# EasyEDA Pro project STM32G303的双FOC电机驱动.eprj, board motor_drivev1.3 (continued)
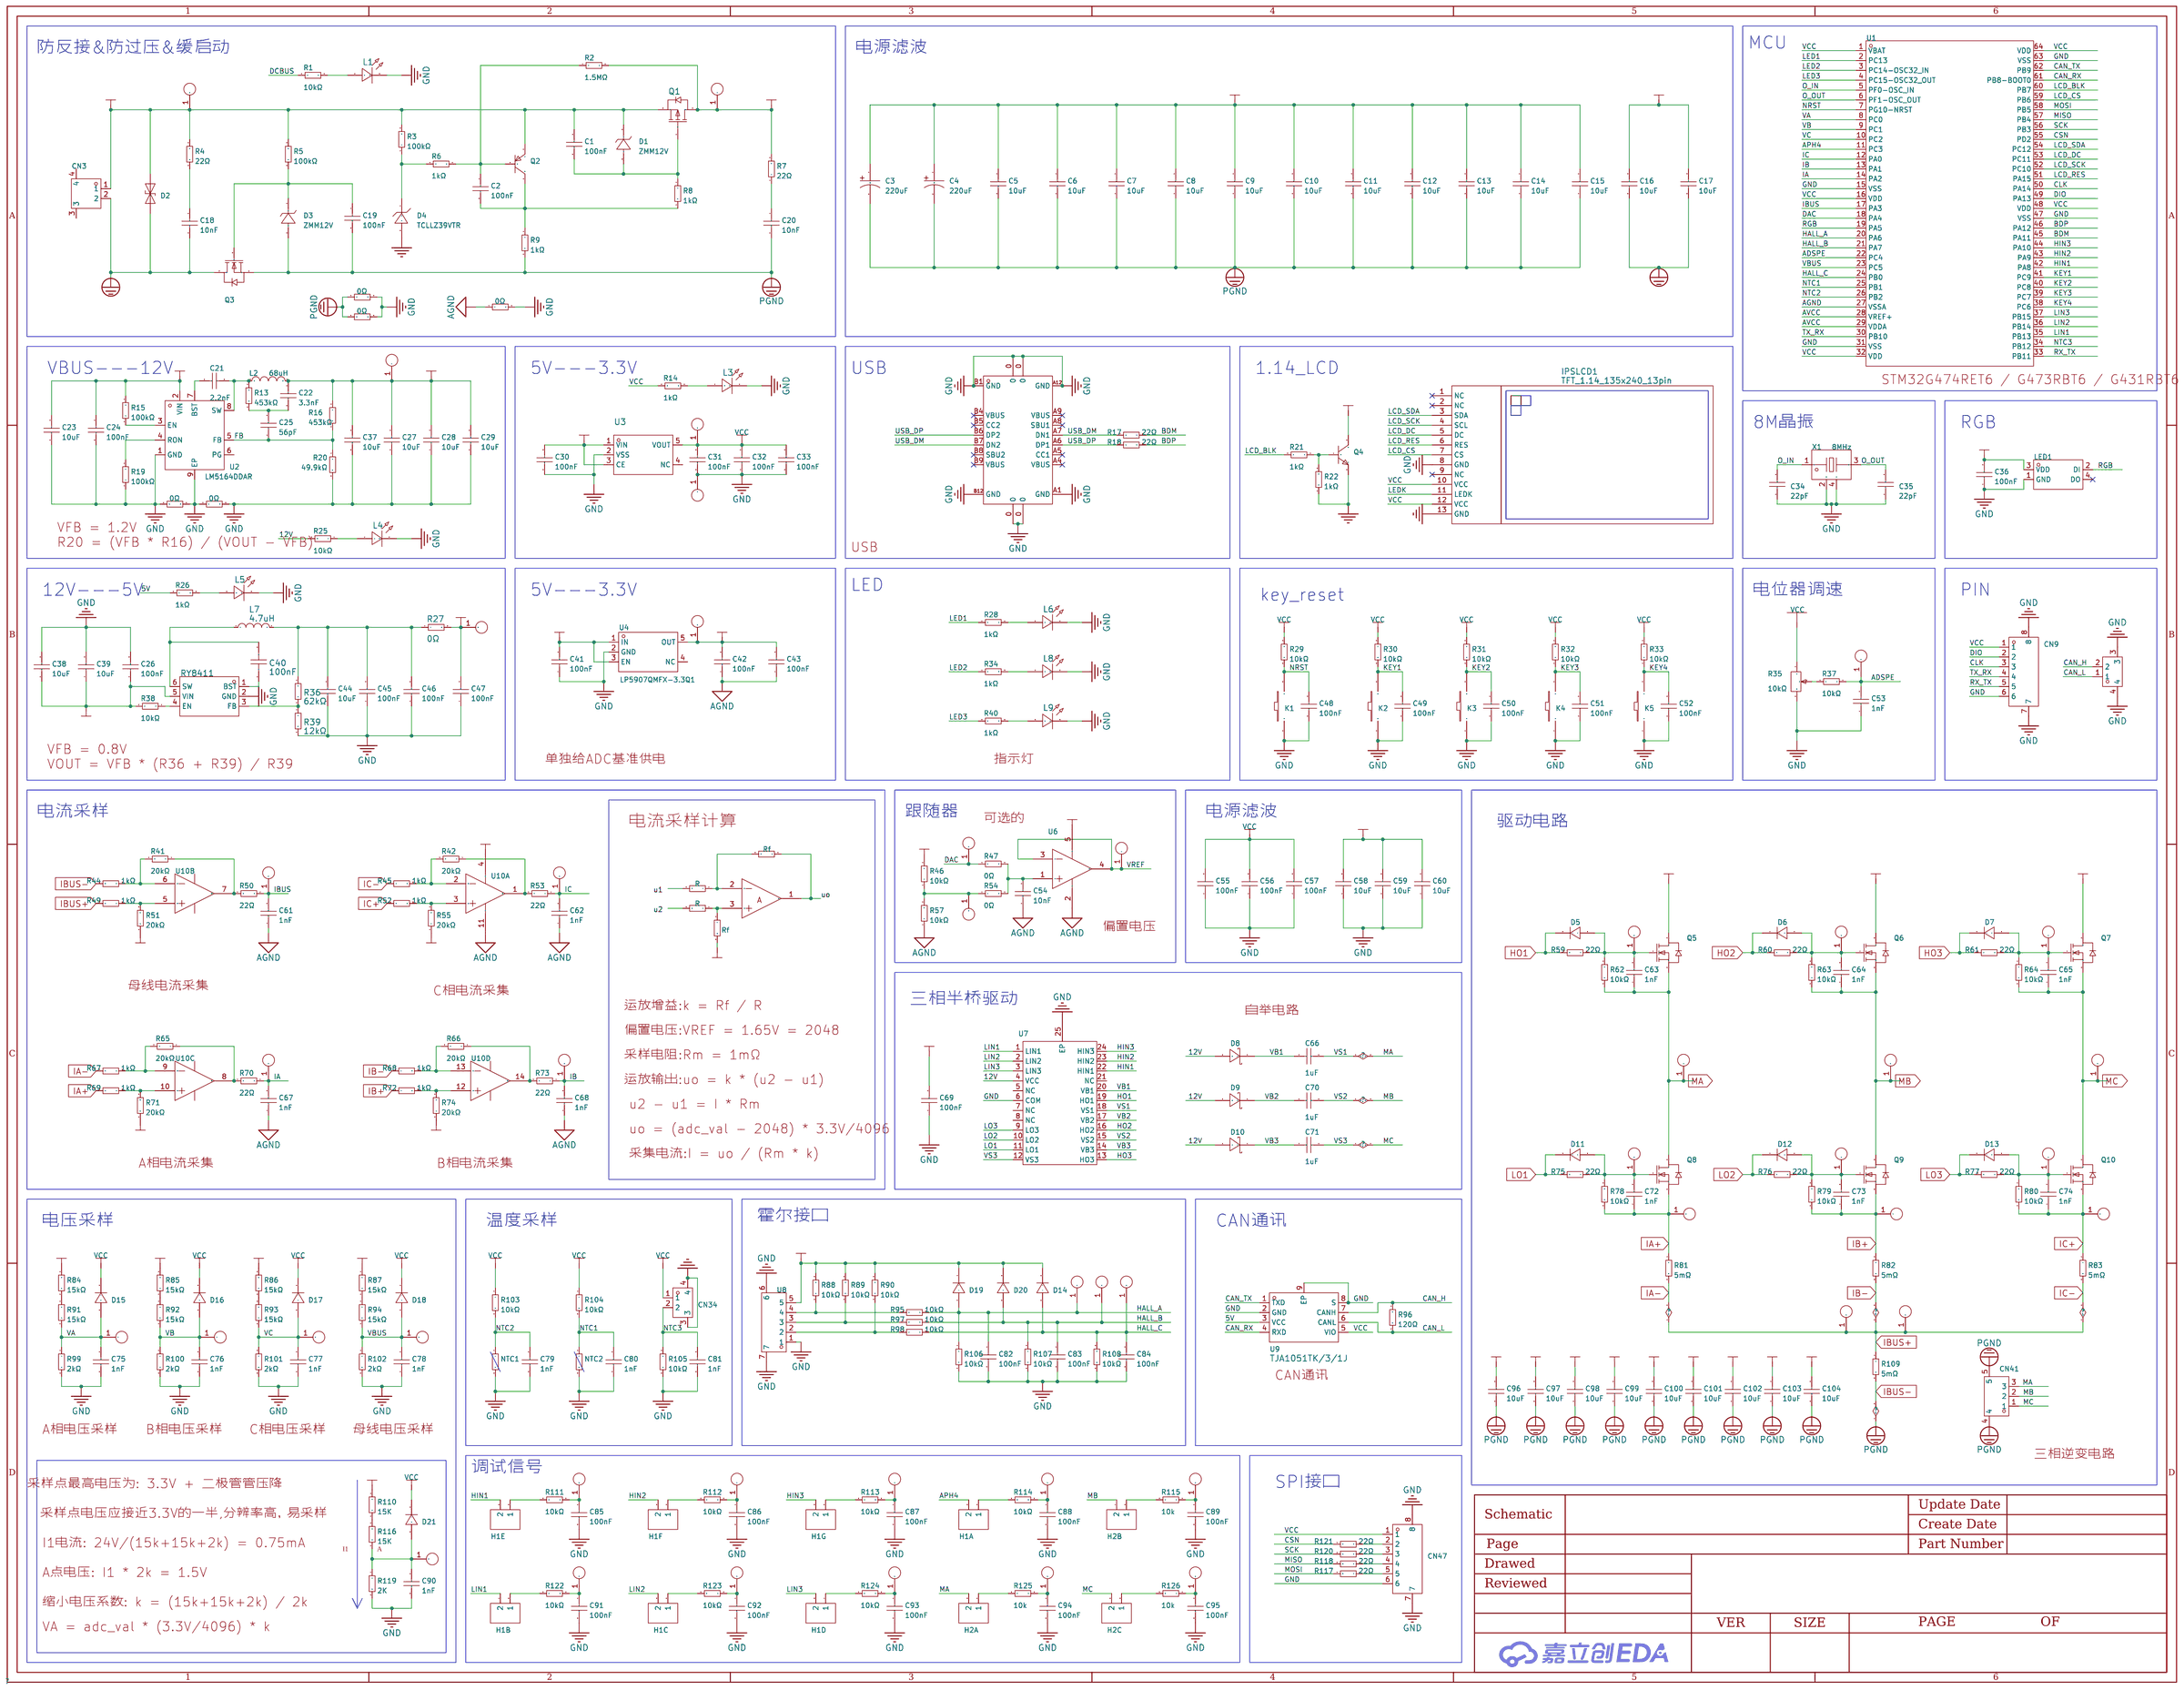
[diagram p0: schematic sheet]
## Routing (per net, layer and track width the routed paths; a pad name or vN(x,y) marks a point on that pad's centre or on a via; arc(x,y) is an arc through that point) (continued)
MB2: length 29.8
  Top Layer w0.254: v2(74.66,12.34) 76,13.67 C113.1 75.94,15.44 R132.2 ; U22.15 83.87,28.28 84.51,27.64 84.51,23.22 H2.3
  Inner2 w0.254: v1(88.13,30.75) 85.46,30.75 81.14,26.44 81.14,23.13 81.52,22.75 84.04,22.75 H2.3
  Bottom Layer w0.254: v1(88.13,30.75) 87.81,30.75 C106.1
  Bottom Layer w0.762: Q36.6 74.96,12.63 v2(74.66,12.34)
  vias: v2(73.52,13.12) v2(73.52,12.18) v2(73.52,10.89) v2(74.3,13.28) v2(74.66,10.89) v2(74.73,11.7) v2(75.9,12.24) v2(75.9,10.83) v2(76.77,11.5) v2(76.77,10.71) v2(77.04,12.18)
MC: length 43.3
  Top Layer w0.254: C71.1 41.14,35.23 43.2,33.17 v2(43.61,33.17) ; U7.12 40.54,24.55 v2(41.01,24.09)
  Top Layer w0.762: H1.4 26.08,23.14 27.74,21.48 v2(28.56,21.48)
  Bottom Layer w0.254: 28.92,21.21 31.8,24.09 v2(41.01,24.09) 41.94,25.02 42.05,24.91 42.72,24.91 44.44,26.63 44.44,30.82 43.61,31.64 v2(43.61,33.17)
  Bottom Layer w0.762: v2(28.56,21.48) 28.92,21.12 Q32.8
  vias: v2(24.24,21.16) v2(24.5,20.47) v2(25.48,21.17) v2(25.48,20.69) v2(25.83,19.96) v2(26.46,21.17) v2(26.64,20.47) v2(26.64,19.61)
MC2: length 43.7
  Top Layer w0.254: v2(82.03,24.78) 82.07,24.83 U22.12 ; R133.2 75.69,4.27 C114.1 77.65,7.32 v2(77.08,7.89)
  Top Layer w0.762: v2(84.42,18.94) 84.42,8.95 83.14,7.67 82.38,7.67 82.03,8.02 80.23,8.02 79.97,7.77 79.01,7.77 78.95,7.7 77.33,7.7 77.11,7.92
  Inner1 w0.254: v2(86.09,27.77) 84.49,26.17 82.67,26.17 82.49,25.99 82.49,24.99 82.28,24.78 v2(82.03,24.78)
  Bottom Layer w0.254: C107.1 87.24,27.77 v2(86.09,27.77) ; v2(82.03,24.78) 82.47,24.34 82.47,20.09 83.62,18.94 v2(84.42,18.94)
  Bottom Layer w0.762: v2(77.08,7.89) 74.11,7.89 Q38.8
  vias: v2(73.22,8.17) v2(73.22,7.43) v2(73.22,6.52) v2(74.35,8.15) v2(74.45,7.43) v2(74.6,6.5) v2(75.52,8.15) v2(75.52,7.43) v2(75.52,6.7)
MT2CK: length 90.9
  Top Layer w0.254: U32.10 66.62,51.18 67.23,50.56 67.23,49.99 67.42,49.8 v1(75.74,49.8)
  Inner1 w0.254: v1(75.74,49.8) 78.41,52.47 78.41,54.31 81.52,57.42 86.09,57.42 88.57,54.95 88.57,51.52 90.09,49.99 91.74,49.99 93.47,48.27 97.22,48.27 97.4,48.09 97.4,47.83 97.21,47.64 97.21,38.62 97.53,38.3 97.53,31.33 95.75,29.55 95.75,6.12 94.52,4.89 CN76.5
MT2CS: length 46.1
  Top Layer w0.254: v2(77.9,42.37) 77.9,43.61 U32.51
  Inner1 w0.254: CN76.4 90.54,7.89 88.82,9.61 88.82,12.53 92.19,15.89 92.19,25.67 91.04,26.83 88.87,26.83 88.87,26.9 87.81,27.96 87.81,29.1 85.91,31 84.89,31 81.14,34.75 81.14,38.63 77.9,41.87 v2(77.9,42.37)
MT2DO: length 43.3
  Top Layer w0.254: v2(83.62,42.18) 82.03,42.18 79.54,44.68 U32.53
  Inner1 w0.254: CN76.2 90.94,14.07 92.6,15.73 92.6,25.84 91.05,27.39 89.65,27.39 89.65,36.15 v2(83.62,42.18)
MTCK: length 109
  Top Layer w0.254: U32.89 69.78,56.02 70.28,55.52 v2(70.28,55.14)
  Inner1 w0.254: CN75.5 5.96,11.23 5.96,20.4 9.64,24.09 9.64,46.44 17.39,54.18 23.99,54.18 31.04,61.23 53.84,61.23 54.03,61.42 54.28,61.42 57.39,58.31 67.11,58.31 v2(70.28,55.14)
MTCS: length 120
  Top Layer w0.254: v2(72.57,55.64) 72.78,55.86 U32.83
  Inner1 w0.254: CN75.4 9.3,8.04 7.86,9.48 5.07,9.48 4.5,10.05 4.5,14.01 5.55,15.07 5.55,20.57 9.23,24.25 9.23,46.61 17.64,55.01 22.91,55.01 31.93,64.03 33.63,64.03 34.01,63.65 35.48,63.65 37.3,61.83 54.45,61.83 57.46,58.82 69.39,58.82 v2(72.57,55.64)
MTDO: length 92.4
  Top Layer w0.254: U32.31 66.78,40.52 64.98,38.72 64.73,38.72 64.69,38.75 v1(62.41,38.75)
  Inner2 w0.254: CN75.2 10.89,4.89 11.99,5.99 11.99,10.31 7.35,14.94 7.35,26.5 12.94,32.09 48.88,32.09 55.55,38.75 v1(62.41,38.75)
NRST: length 9.2
  Top Layer w0.254: U32.14 60.38,49.18 59.04,47.83 58.15,47.83 57.14,46.82 57.14,45.1 56.7,44.66 U52.2
O_IN: length 10.7
  Top Layer w0.254: U32.12 58.02,50.18 57.58,49.74 55.49,49.74 54.76,50.46 X1.1 54.81,50.82 C34.2
O_OUT: length 8.9
  Top Layer w0.254: C35.2 56.46,46.73 X1.3 58.7,48.58 59.8,49.68 U32.13
OUT3: length 35.2
  Top Layer w0.254: v2(60.06,55.84) 60.22,55.68 U32.1
  Inner1 w0.254: v2(60.06,55.84) 59.42,55.84 42.47,38.88 42.47,37.48 41.39,36.4 v2(38.28,36.4)
  Bottom Layer w0.254: R203.2 37.06,36.4 v2(38.28,36.4)
RELAY1: length 30.5
  Top Layer w0.254: v2(59.61,55.01) 59.78,55.18 U32.2 ; v2(46.47,35.96) R176.2
  Inner2 w0.254: v2(59.61,55.01) 56.69,55.01 52.44,50.76 52.44,41.93 v2(46.47,35.96)
RELAY2: length 30.1
  Top Layer w0.254: v2(46.02,48.91) 46.02,48.73 R177.2 ; U32.3 v2(64.69,54.68)
  Inner1 w0.254: v2(64.69,54.68) 64.33,54.68 62.34,56.66 46.85,56.66 46.28,56.09 46.28,49.17 v2(46.02,48.91)
RS485-B: length 49.1
  Top Layer w0.254: U42.4 95.55,34.88 96.44,35.77 96.44,37.42 95.75,38.12 91.72,38.12 89.93,36.33 R195.2 ; R195.2 89.85,36.28 88.76,36.28 88.13,35.64 U41.7 85.56,35.64 85.51,35.59 84.65,35.59 84.47,35.77 84.32,35.77 84.32,37.42 82.78,38.95 82.78,39.47 ; R195.2 89.9,37.84 88.08,39.67 D34.2
  Inner1 w0.508: U42.4 96.23,34.88 96.99,35.64 96.99,38.08 96.63,38.44 95.22,38.44 91.17,42.49 91.17,47.26 88.24,50.2 CN77.2
RS485_A: length 48.9
  Top Layer w0.254: v2(92,31.2) 90.93,32.26 D33.2 89.9,32.52 R195.1 88.96,34.83 v1(88.63,34.5) 88.51,34.37 U41.6 ; v2(84.82,38.44) 84.82,39.22 R196.1
  Inner1 w0.254: v1(88.63,34.5) 88.63,34.63 v2(84.82,38.44)
  Inner1 w0.508: U42.6 94.46,36.88 89.88,41.47 89.88,43.42 89.08,44.22 88.57,44.22 88.46,44.11 87.96,44.11 87.15,44.91 86.24,44.91 84.46,46.69 84.46,50.59 86.08,52.2 CN77.3
  Bottom Layer w0.254: v2(92,31.2) 96.06,31.2 96.63,31.77 96.63,35.33 95.08,36.88 U42.6
RX1: length 26.6
  Top Layer w0.254: U32.34 68.28,47.61 v2(68.19,47.71)
  Bottom Layer w0.254: v2(68.19,47.71) 48.63,47.71 47.95,48.39 U50.2
RX3: length 14.8
  Top Layer w0.203: R194.1 78.97,34.88 78.83,35.02 76.15,35.02 74.28,36.89
  Top Layer w0.254: R194.1 81.13,33.36 U41.4 ; 74.28,36.89 U32.46
RX_TX: length 16.1
  Top Layer w0.254: U32.77 75.78,58.28 76.45,58.95 81.58,58.95 v2(84,56.53)
  Inner1 w0.254: CN81.5 82.55,52.74 84,54.18 v2(84,56.53)
SCL: length 25
  Top Layer w0.254: U31.6 80.19,68.21 R173.1 ; v2(66.85,55.51) 66.78,55.58 U32.95
  Top Layer w0.508: U31.6 80.19,65.42 v2(79.39,64.63)
  Bottom Layer w0.254: v2(66.85,55.51) 66.85,58.92 67.12,59.19 73.96,59.19 v2(79.39,64.63)
SDA: length 27.4
  Top Layer w0.254: R174.1 82.16,67.91 81.46,67.21 U31.5 81.39,66.48 v2(81.39,63.9) ; v2(67.68,55.45) 67.78,55.45 U32.93
  Bottom Layer w0.254: v2(67.68,55.45) 67.68,56.47 67.81,56.47 67.81,58.38 76.12,58.38 76.12,60.79 79.24,63.9 v2(81.39,63.9)
TX1: length 23.1
  Top Layer w0.254: U32.33 67.78,45.95 v2(67.61,46.12) ; U50.1 51.36,47.42 v2(51.36,46.95)
  Bottom Layer w0.254: v2(51.36,46.95) 66.79,46.95 v2(67.61,46.12)
TX3: length 12.5
  Top Layer w0.203: U41.1 78.41,36.91 78.09,37.23 77.58,37.23 76.38,36.02 76.12,36.02 74.78,37.37 U32.47
TX_RX: length 24.1
  Top Layer w0.254: U32.25 62.73,43.65 v2(62.09,43.01)
  Inner2 w0.254: CN81.4 81.39,50.8 80.68,51.52 73.96,51.52 66.15,43.71 62.79,43.71 v2(62.09,43.01)
VB1: length 4.2
  Top Layer w0.254: U7.20 40.04,30.26 39.5,30.8 C66.2 D8.1
VB2: length 11
  Top Layer w0.254: U7.17 41.79,28.2 42.72,29.14 42.72,31.7 42.21,32.21 39.8,32.21 39.63,32.39 C70.2 39.5,33.1 D9.1
VB3: length 14.9
  Top Layer w0.254: v1(39.36,34.5) 39.63,34.77 C71.2 39.5,35.13 D10.1 ; U7.14 41.7,26.7 v1(42.34,26.05)
  Bottom Layer w0.254: v1(42.34,26.05) 42.53,26.24 42.53,32.91 40.95,34.5 v1(39.36,34.5)
VREF: length 99.5
  Top Layer w0.254: v1(64.88,19.27) 67.88,19.27 68.06,19.45 68.06,19.84 R158.1 ; 60.18,35.52 65.28,35.52 R161.1 65.95,36.01 66.35,36.4 v1(66.35,36.72) ; 60.18,35.52 54.7,35.52 53.23,34.05 R74.1 ; 60.18,35.52 60.18,25.84 60.09,25.74 ; R157.1 74.16,29.37 74.16,29.99 73.9,30.25 v1(71.11,30.25)
  Top Layer w0.381: R55.1 45.33,13.42 45.77,12.97 47.26,12.97 U6.4 ; R51.1 49.15,16.48 v1(48.63,15.96) ; 58.2,25.74 61.78,25.74 R162.1 ; 58.2,25.74 58.28,25.65 58.28,12.15 v1(57.26,11.13) ; 58.2,25.74 R71.1
  Top Layer w0.508: U6.4 U6.3 49.71,13.13 R51.1
  Inner1 w0.254: v1(57.26,11.13) 57.26,17.04 59.5,19.27 v1(64.88,19.27)
  Inner1 w0.381: v1(48.63,15.96) 51.3,15.96 56.12,11.13 v1(57.26,11.13)
  Bottom Layer w0.254: v1(71.11,30.25) 71.11,31.96 v1(66.35,36.72)
$1N704042: length 4.1
  Top Layer w0.508: LED1.2 93.14,42.37 R28.1
$1N1663438: length 2.7
  Top Layer w0.254: R167.1 67.28,59.7 U32.94
$1N1664238: length 13.5
  Top Layer w0.508: 95.94,42.63 97.37,44.07 97.37,46.46 97.02,46.82 92.06,46.82 89.78,44.53 R172.1
$1N1664722: length 7.6
  Top Layer w0.254: CN86.1 55.94,54.18 U32.4
$1N1664879: length 18.4
  Top Layer w0.254: v2(58.53,53.36) 59.87,53.36 60.18,53.68 U32.5 ; v2(55.49,61.8) 55.04,62.25 SW1.2 54.37,63.23 R175.1
  Bottom Layer w0.254: v2(58.53,53.36) 55.49,56.41 v2(55.49,61.8)
$1N1666049: length 6
  Top Layer w0.254: Q20.3 42.6,38.82 41.78,38 RL1.5
  Bottom Layer w0.762: D31.2 40.41,38.7 RL1.5
$1N1666175: length 3.4
  Top Layer w0.254: R176.1 43.81,37.29 44.39,37.87 Q20.1
$1N1666422: length 5.8
  Top Layer w0.508: RL2.5 41.31,49.2 Q21.3
  Bottom Layer w0.762: D32.2 40.55,51.01 RL2.5
$1N1666434: length 2.9
  Top Layer w0.508: R177.1 44.12,48.33 44.12,49.1 45.14,50.12 Q21.1
$1N1666848: length 15.8
  Bottom Layer w1.27: Q22.8 24.14,41.61 16.05,41.61 14.08,39.64 ; 13.89,39.39 13.89,35.6 tm3.1
$1N1667282: length 4.2
  Top Layer w0.254: U32.86 71.28,61.33 CN88.1
$1N1667288: length 2.6
  Top Layer w0.254: CN89.1 70.78,59.12 U32.87
$1N1667505: length 18.5
  Bottom Layer w1.016: tm2.2 19.06,49.7 21.89,52.53 26.1,52.53 RL2.2
$1N1667520: length 23.1
  Inner1 w1.016: RL1.2 27.42,48.45 27.42,51.07 27.04,51.45 19.53,51.45 tm2.1
$1N1669768: length 4.3
  Top Layer w0.254: Q25.1 51.54,57.68 R192.2 53.71,57.75 R191.1
$1N1670130: length 6.4
  Top Layer w0.254: BUZZER1.2 47.5,63.02 Q25.3
$1N1670137: length 7.1
  Top Layer w0.508: R190.1 43.99,61.53 BUZZER1.1
$1N1670397: length 11.5
  Top Layer w0.254: U41.2 78.3,35.64 Q26.3 ; U41.2 U41.3 ; U41.2 82.41,35.64 82.57,35.48 82.82,35.48 83.3,35.96 83.3,37.27 81.11,39.46 R193.2
$1N1670491: length 8.3
  Top Layer w0.254: v2(78.54,39.58) 78.85,39.26 Q26.1 ; v2(78.22,34.31) 77.47,33.56 R194.2
  Bottom Layer w0.254: v2(78.22,34.31) 78.22,39.26 v2(78.54,39.58)
$1N1676030: length 3.9
  Bottom Layer w0.254: Q22.4 27.83,40.83 28.06,40.6 ; R198.2 28.06,40.6 ; 28.06,40.6 R199.2
$1N1676080: length 2.8
  Bottom Layer w0.254: Q23.3 31.63,42.43 29.7,40.5 R199.1
$1N1676108: length 2.2
  Bottom Layer w0.254: Q23.2 36.24,43.39 R200.2
$1N1676142: length 2.7
  Bottom Layer w0.254: R201.2 34.08,38.86 Q24.3
$1N1676222: length 4.3
  Bottom Layer w0.254: R203.1 35.1,36.86 Q24.1 33.06,36.73 R202.1
$2N371: length 2.2
  Top Layer w0.254: D10.2 35.39,35.07 R217.2
$2N3876: length 8.9
  Top Layer w0.508: D5.2 26.31,2.6 26.29,2.58 ; 26.29,2.58 26.52,2.58 R59.1 ; 26.29,2.58 C63.2 24.55,2.51 R62.1
  Bottom Layer w0.254: v2(25.83,4.34) 24.28,5.88 Q27.4
$2N3878: length 11.7
  Top Layer w0.254: v2(31.9,3.86) 32.48,3.28 C72.2 34.59,3.28 R78.1 37.21,3.2 37.4,3.39 ; 37.4,3.39 37.4,2.28 D11.2 ; 37.4,3.39 R75.1
  Bottom Layer w0.254: v2(31.9,3.86) 32.5,4.46 32.5,5.67 31.82,6.35 Q28.4
$2N3881: length 10.6
  Top Layer w0.254: R63.1 24.24,11.13 v1(23.17,10.05)
  Top Layer w0.508: C64.2 24.12,11.02 R63.1 26.57,11.14 D6.2 27.11,10.84 R60.1
  Bottom Layer w0.254: v1(23.17,10.05) 23.18,10.07 Q29.4
$2N3883: length 10.7
  Top Layer w0.254: v2(31.04,10.56) 31.09,10.51 R79.1 33.02,10.58 C73.2 37.06,10.58 ; 37.06,10.58 37.45,10.58 R76.1 ; 37.06,10.58 37.11,10.62 D12.2
  Bottom Layer w0.254: v2(31.04,10.56) 31.04,12.11 31.14,12.22 Q30.4
$2N3886: length 11.2
  Top Layer w0.254: R61.1 28.76,18.14 D7.2 28.1,18.06 R64.1 ; v1(25.07,16.78) 25.07,17.5 C65.2
  Top Layer w0.762: C65.2 26.21,18.07 R64.1
  Bottom Layer w0.254: Q31.4 23.01,18.84 v1(25.07,16.78)
$2N3888: length 9.2
  Top Layer w0.254: C74.2 32.86,17.99 v1(31.99,17.99) ; D13.2 37.02,19.6 37.02,17.67 36.75,17.94 R80.1
  Top Layer w0.762: C74.2 34.65,18.01 R80.1
  Bottom Layer w0.254: v1(31.99,17.99) 31.43,18.55 31.43,18.95 30.95,19.43 Q32.4
$2N10628: length 6.2
  Top Layer w0.254: R42.1 49.81,20.41 48.3,21.92 47.64,21.92 ; 47.64,21.92 R53.2 ; 47.64,21.92 49.22,23.5 U10.1
$2N10630: length 14.3
  Top Layer w0.254: U10.3 50.52,26.39 50.34,26.56 47.87,26.56 46.65,25.35 46.65,24.21 ; 45.26,17.86 45.26,22.73 46.72,24.18 46.72,24.21
$2N10631: length 4.6
  Top Layer w0.254: R45.2 51.55,21.92 R42.2 49.87,21.95 U10.2
$2N10633: length 7.6
  Top Layer w0.254: 57,24.47 57,23.59 55.26,21.86 R50.2
  Top Layer w0.305: R50.2 55.23,22.43 54.79,22.88 54.79,24.02 54.16,24.65 U10.7
$2N10635: length 13.8
  Top Layer w0.254: U10.5 v1(51.82,26.37) ; R51.2 R49.2 52.45,17.98 v1(52.69,17.74)
  Inner1 w0.254: v1(51.82,26.37) 51.82,18.61 v1(52.69,17.74)
$2N10636: length 8.7
  Top Layer w0.254: R44.2 53.33,22.12 52.47,22.98 U10.6 52.47,26.02 53.01,26.56 53.64,26.56 54.84,25.37 54.84,25.12 55.49,24.47
$2N10642: length 7.9
  Top Layer w0.254: 48.42,30.05 48.44,30.07 48.44,33.61 48.76,33.93 49.46,33.93 R66.1
  Top Layer w0.508: U10.14 49.02,30.05 47.69,30.05 47.22,30.52 47.22,31.3
$2N10644: length 4.8
  Top Layer w0.254: U10.12 50.52,32.2 50.8,32.47 R72.2 53.14,32.47 R74.2
$2N10645: length 8.9
  Top Layer w0.254: U10.13 49.87,32.25 R66.2 49.91,32.54 50.34,32.98 50.34,34.88 50.15,35.07 48.25,35.07 47.22,34.05 R68.2
$2N10649: length 5.8
  Top Layer w0.254: R70.2 54.26,31.69 53.57,31.69 53.39,31.52 53.39,30.52 U10.8 55.3,30.25 R65.1
$2N10651: length 7.6
  Top Layer w0.254: U10.10 51.82,28.58 53.01,27.39 R69.2 R71.2
$2N10652: length 10
  Top Layer w0.254: U10.9 52.47,29.14 53.07,28.53 54.69,28.53 54.82,28.66 56.38,28.66 56.94,29.22 R65.2
  Top Layer w0.381: R67.2 58.92,32.09 R65.2
$2N26375: length 6.6
  Bottom Layer w0.254: R209.2 96.66,51.98 CN78.2 94.4,51.78 R207.1
$2N26379: length 6.4
  Bottom Layer w0.254: R210.2 97.04,54.48 CN78.4 94.72,55 R208.1
$2N32704: length 1.9
  Top Layer w0.254: R215.2 34.88,31.07 35.01,31.2
$2N32706: length 2
  Top Layer w0.254: R216.2 34.95,32.98 D9.2
$3N1206: length 2.7
  Top Layer w0.508: R1.1 15.99,57.37 L1.1
$3N1659: length 2.4
  Top Layer w0.254: R14.2 51.85,44.72 L3.1
$3N4350: length 3.8
  Top Layer w0.254: R178.1 60.36,67.77 U55.4
$3N4694: length 13
  Top Layer w0.254: U55.6 60.71,65.94 61.86,64.79 63.75,64.79 65.15,63.39 C131.2
  Top Layer w0.508: U47.1 58.94,62.47 U57.1
  Top Layer w0.762: U55.6 59.79,65.29 U47.1
$3N4858: length 2.9
  Top Layer w0.254: U55.1 64,65.94 65.15,64.79 C131.1
$3N4949: length 15.8
  Top Layer w0.254: C132.1 73.95,65.86 R179.1 72.19,67.7 71.99,67.9 72.33,68.24 72.63,68.24 72.81,68.42 72.81,68.67 72.63,68.85 68.69,68.85 67.68,67.84 U55.3
$3N5491: length 2.3
  Top Layer w0.508: U56.4 15.23,32.4 R181.1
$3N5497: length 14.2
  Top Layer w0.254: C135.2 23.99,29.67 23.86,29.55 17.75,29.55 17.57,29.72
  Top Layer w0.508: U58.1 16.29,27.9 U49.1 17.57,28.03 U56.6
$3N5510: length 2.7
  Top Layer w0.508: U56.1 22.53,30.5 C135.1
$3N6069: length 14.2
  Top Layer w0.508: U56.3 20.18,32.4 21.4,33.62 R183.2 25.75,33.62 25.8,33.67 C136.1 26.91,31.83 28.63,30.12 28.63,27.89 R182.1
$3N15639: length 4.6
  Top Layer w0.508: 49.18,7.59 49.18,6.23 R57.2 ; 49.18,7.59 R54.1 ; 49.18,7.59 47.68,7.59 R46.1
$3N15644: length 4
  Top Layer w0.508: 49.96,10.44 49.96,10.97 U6.1 ; 49.96,10.44 R54.2 ; 49.96,10.44 52,10.44 C54.2
$4N3072: length 37.7
  Top Layer w0.254: R131.1 92.01,29.02 C112.2 94.34,28.65 95.44,28.65 95.62,28.47 95.62,19.83 92.32,16.53 v1(88.89,16.53)
  Bottom Layer w0.254: v1(88.89,16.53) 84.13,16.53 81.39,19.26 81.39,21.56 R141.1 ; Q33.4 77.97,18.47 77.97,20.72 78.76,21.52 D25.2
  Bottom Layer w0.762: R141.1 80.72,21.52 79.3,21.52
$4N3074: length 12.3
  Top Layer w0.203: v1(72.38,18.88) 73.77,18.88 74.41,18.24 74.41,16.81 74.1,16.5 73.85,16.5 C115.2
  Top Layer w0.254: D28.2 68.78,15.61 R144.1 71.04,16.09 R134.1 73.2,15.84 C115.2
  Bottom Layer w0.203: v1(72.38,18.88) 72.3,18.8 Q34.4
$4N3077: length 9.6
  Top Layer w0.254: v2(77.58,14.62) 77.58,15.31 C113.2 77.5,17.3 R132.1 77.45,18.71 78.66,19.92 D26.2 77.18,19.99 R142.1
  Bottom Layer w0.254: Q35.4 77.58,13.62 v2(77.58,14.62)
$4N3079: length 13.6
  Top Layer w0.203: C116.2 70.11,9.94 70.85,10.69 v1(70.85,13.8)
  Top Layer w0.254: D29.2 64.4,9.45 R145.1 66.15,9.81 66.32,9.64 67.19,9.64 67.33,9.78 ; R135.1 68.88,9.81 C116.2
  Bottom Layer w0.203: v1(70.85,13.8) 71.15,13.8 71.67,13.28 Q36.4
$4N3082: length 31.9
  Top Layer w0.254: v1(82.86,1.8) 82.06,1.8 D27.2 81.04,2.82 R143.1 79.5,2.77 C114.2 77.64,2.76 R133.1
  Inner1 w0.254: v1(76.89,9.54) 72.38,9.54 71.3,8.46 71.3,4.46 73.96,1.8 v1(82.86,1.8)
  Bottom Layer w0.254: Q37.4 77.72,8.91 77.33,8.91 77.15,9.09 77.15,9.28 v1(76.89,9.54)
$4N3084: length 16
  Top Layer w0.203: C117.2 66.78,3.72 R136.1 65.56,3.9 ; 65.56,3.9 65.77,4.12 v1(65.77,7.07) ; 65.56,3.9 R146.1 64.59,3.67 D30.2
  Bottom Layer w0.203: Q38.4 67.28,8.58 v1(65.77,7.07)
$4N4584: length 5.7
  Top Layer w0.254: R156.1 66.42,20.22 64.91,21.73 ; U25.1 66.05,22.86 64.91,21.73 ; 64.91,21.73 R164.2
$4N4586: length 11.6
  Top Layer w0.203: R158.2 69.34,21.79 69.46,21.67 69.46,19.64 68.5,18.69 67.23,18.69 67.06,18.52 65.77,18.52 64.91,17.66 R150.2
  Top Layer w0.254: R158.2 68.45,21.79 67.35,22.89 U25.3
$4N4587: length 19.3
  Top Layer w0.203: U25.2 66.7,21.76 R156.2
  Top Layer w0.254: U25.2 66.7,25.89 66.54,26.05 65.84,26.05 65.08,25.29 65.08,23.51 64.31,22.75 61.52,22.75 60.63,21.86 60.63,18.37 61.2,17.8 62.41,17.8 62.42,17.79 R148.2
$4N4589: length 5.5
  Top Layer w0.254: 72.38,24.03 71.95,24.46 69.95,24.46 70.35,24.06 R163.2
$4N4591: length 7.5
  Top Layer w0.254: R157.2 72.58,28.98 72.25,28.66 72.25,27.7 R149.2 70.28,27.51 68.65,25.88 U25.5
$4N4592: length 10
  Top Layer w0.254: 72.45,25.67 71.79,25.67 71.28,26.18 69.71,26.18 69.3,25.77 U25.6 ; R155.2 73.46,25.54 74.28,24.72 R147.2
$4N4598: length 5.3
  Top Layer w0.254: R160.1 63.67,33.04 R166.2 63.98,31.89 64.58,31.89 64.76,31.71 64.76,31.35 U25.14
$4N4600: length 8.2
  Top Layer w0.254: U25.12 67.35,28.64 64.82,26.12 R162.2 R154.2
$4N4601: length 13.7
  Top Layer w0.254: R160.2 62.28,33.67 62.28,34.18 62.46,34.36 64.12,34.36 65.14,33.35 65.14,32.78 66.7,31.23 U25.13 66.7,28.56 66.47,28.34 65.2,28.34 63.74,29.8 R152.2
$4N4605: length 8.8
  Top Layer w0.203: R159.1 71.8,35.89 73.42,34.26 ; 73.42,34.26 R165.2 ; 73.42,34.26 73.35,34.26 72.08,32.99 71.38,32.99 71.23,32.85 71.23,32 69.95,30.71 69.95,30.06
$4N4607: length 6.6
  Top Layer w0.254: U25.10 68.65,32.39 67.55,33.48 R153.2 67.49,34.51 R161.2
$4N4608: length 6.3
  Top Layer w0.254: U25.9 69.3,34.16 R151.2 69.52,34.38 71.42,34.38
$4N18745: length 2.3
  Bottom Layer w0.254: R204.2 79.08,33.55 D22.2
$4N18747: length 3.3
  Bottom Layer w0.254: R205.2 D23.2
$4N18749: length 4.3
  Bottom Layer w0.254: R206.2 80.51,29.74 80.57,29.8 80.92,29.8 D24.2
$4N19011: length 9.7
  Top Layer w0.254: R211.1 91.17,58.5 91.81,59.14 92.59,59.14 CN80.2
  Bottom Layer w0.254: CN80.2 96.41,61.13 R213.2
$4N19015: length 6.8
  Top Layer w0.254: v2(91.17,65.3) 90.79,65.3
  Top Layer w0.508: R212.1 90.74,65.36 R214.2
  Bottom Layer w0.254: CN80.4 94.58,64.49 93.78,65.3 v2(91.17,65.3)

## Copper pours and planes (outline as drawn; the poured copper is in the pictures)
AGND on Top Layer: 58.43,42.88 61.14,42.88 61.14,39.77 58.43,39.77
GND on Top Layer: -6.68,72.47 113.78,72.47 113.78,1.29 -6.68,1.29
GND on Bottom Layer: -4.97,72.79 111.11,72.79 111.11,-0.3 -4.97,-0.3
GND on Inner1: -5.85,74.38 113.46,74.38 113.46,-6.65 -5.85,-6.65
VCC on Top Layer: 44.31,46.75 48.57,46.75 48.57,42.88 44.31,42.88
DCBUS on Top Layer: 24.18,57.8 41.01,57.8 41.01,53.42 24.18,53.42
DCBUS on Top Layer: -0.33,70.06 54.79,70.06 54.79,60.98 -0.33,60.98
DCBUS on Top Layer: 20.03,68.47 24.63,68.47 24.63,55.71 20.03,55.71
DCBUS on Top Layer: 19.1,46.56 41.45,46.56 41.45,39.26 19.1,39.26
DCBUS on Top Layer: 37.45,54.06 39.61,54.06 39.61,45.42 37.45,45.42
DCBUS on Top Layer: -0.33,62.57 20.62,62.57 20.62,34.25 -0.33,34.25
DCBUS on Bottom Layer: -0.33,69.04 9.89,69.04 9.89,27.26 -0.33,27.26
DCBUS on Bottom Layer: 20.97,7.1 81.97,7.1 81.97,0.65 20.97,0.65
DCBUS on Bottom Layer: 5.13,28.47 21.77,28.47 21.77,14.5 5.13,14.5
DCBUS on Bottom Layer: 0.5,69.68 53.01,69.68 53.01,66.16 0.5,66.16
DCBUS on Bottom Layer: 79.96,18.94 83.36,18.94 83.36,5.6 79.96,5.6
DCBUS on Bottom Layer: 7.29,67.84 11.61,67.84 11.61,26.94 7.29,26.94
DCBUS on Bottom Layer: 0.62,32.15 22.35,32.15 22.35,6.14 0.62,6.14
IA2+ on Bottom Layer: 68.63,18.56 72.74,18.56 72.74,15.14 68.63,15.14
IA2- on Bottom Layer: 55.11,19.77 64.06,19.77 64.06,3.19 55.11,3.19
IA+ on Bottom Layer: 30.59,9.48 36.69,9.48 36.69,5.43 30.59,5.43
IA- on Bottom Layer: 41.58,21.99 50.85,21.99 50.85,4.46 41.58,4.46
IB2+ on Bottom Layer: 68.95,12.97 72.7,12.97 72.7,9.49 68.95,9.49
IB+ on Bottom Layer: 30.79,15.26 36.63,15.26 36.63,11.65 30.79,11.65
IC2+ on Bottom Layer: 68.06,8.15 72.19,8.15 72.19,4.08 68.06,4.08
IC+ on Bottom Layer: 30.47,22.31 36.82,22.31 36.82,18.81 30.47,18.81
MA on Top Layer: 9.7,20.52 22.03,20.52 22.03,5.99 9.7,5.99
MA on Top Layer: 21.39,8.59 29.26,8.59 29.26,5.61 21.39,5.61
MA on Bottom Layer: 23.78,8.88 28.63,8.88 28.63,5.73 23.78,5.73
MA on Inner1: 9.77,20.66 28.94,20.66 28.94,5.42 9.77,5.42
MA on Inner2: 9.26,20.28 28.99,20.28 28.99,5.26 9.26,5.26
MA2 on Bottom Layer: 73.1,19.26 78.35,19.26 78.35,16 73.1,16
MA2 on Bottom Layer: 73.21,26.5 91.36,26.5 91.36,18.75 73.21,18.75
MB on Top Layer: 15.2,20.09 24.65,20.09 24.65,13.04 15.2,13.04
MB on Top Layer: 22.85,15.2 30.4,15.2 30.4,12.27 22.85,12.27
MB on Bottom Layer: 22.85,15.18 28.67,15.18 28.67,12.12 22.85,12.12
MB on Inner1: 15.67,20.02 29.84,20.02 29.84,12.15 15.67,12.15
MB on Inner2: 15.55,20.09 30.4,20.09 30.4,12.38 15.55,12.38
MB2 on Top Layer: 72.95,13.93 78.85,13.93 78.85,10.12 72.95,10.12
MB2 on Top Layer: 78.41,24.15 85.77,24.15 85.77,10.12 78.41,10.12
MB2 on Bottom Layer: 73.01,13.54 78.47,13.54 78.47,10.56 73.01,10.56
MB2 on Inner1: 72.88,13.93 78.54,13.93 78.54,10.43 72.88,10.43
MB2 on Inner1: 77.58,24.02 85.9,24.02 85.9,10.21 77.58,10.21
MB2 on Inner2: 72.95,13.74 78.79,13.74 78.79,10.05 72.95,10.05
MC on Top Layer: 26.08,23.14 27.74,21.48 29.9,21.48 29.9,19.42 24.72,19.42 24.5,19.2 23.85,19.85 23.85,20.09 23.73,20.21 22.37,20.21 22.37,23.02 22.49,23.14
MC on Top Layer: 15.94,24.3 24.12,24.3 24.12,19.34 15.94,19.34
MC on Bottom Layer: 22.66,21.74 28.31,21.74 28.31,19.2 22.66,19.2
MC on Inner1: 15.75,24.21 29.13,24.21 29.13,19.51 15.75,19.51
MC on Inner2: 16.28,24.28 30,24.28 30,19.08 16.28,19.08
MC2 on Top Layer: 72.76,8.66 83.49,8.66 83.49,5.54 72.76,5.54
MC2 on Top Layer: 82.22,20.4 85.46,20.4 85.46,7.38 82.22,7.38
MC2 on Bottom Layer: 72.63,9.1 78.41,9.1 78.41,6.05 72.63,6.05
MC2 on Inner1: 75.52,19.83 85.84,19.83 85.84,5.92 75.52,5.92
MC2 on Inner1: 72.7,9.15 78.58,9.15 78.58,5.86 72.7,5.86
MC2 on Inner2: 72.73,9.12 78.77,9.12 78.77,5.73 72.73,5.73

Small or netless copper shapes (teardrops, artwork), in the pictures only: 1 on Top Layer, 3 on Bottom Layer, 1 on Inner1

## Text on the board
Top Solder Mask Layer: [Ver1.3]
Top Silkscreen Layer: 20250802 | 5V | W | G | U | V | USB | 24V
